# EasyEDA Pro project 2-64 M circuit board.eprj

# Schematic FUJICA AX-5
Create Date: 2026-02-10; Page Name: 2-64 M circuit board; Project Name: 2-64 M circuit board; Schematic Name: FUJICA AX-5; Update Date: 2026-02-10; Company: EasyEDA.com; Page Size: A4; Version: V1.0
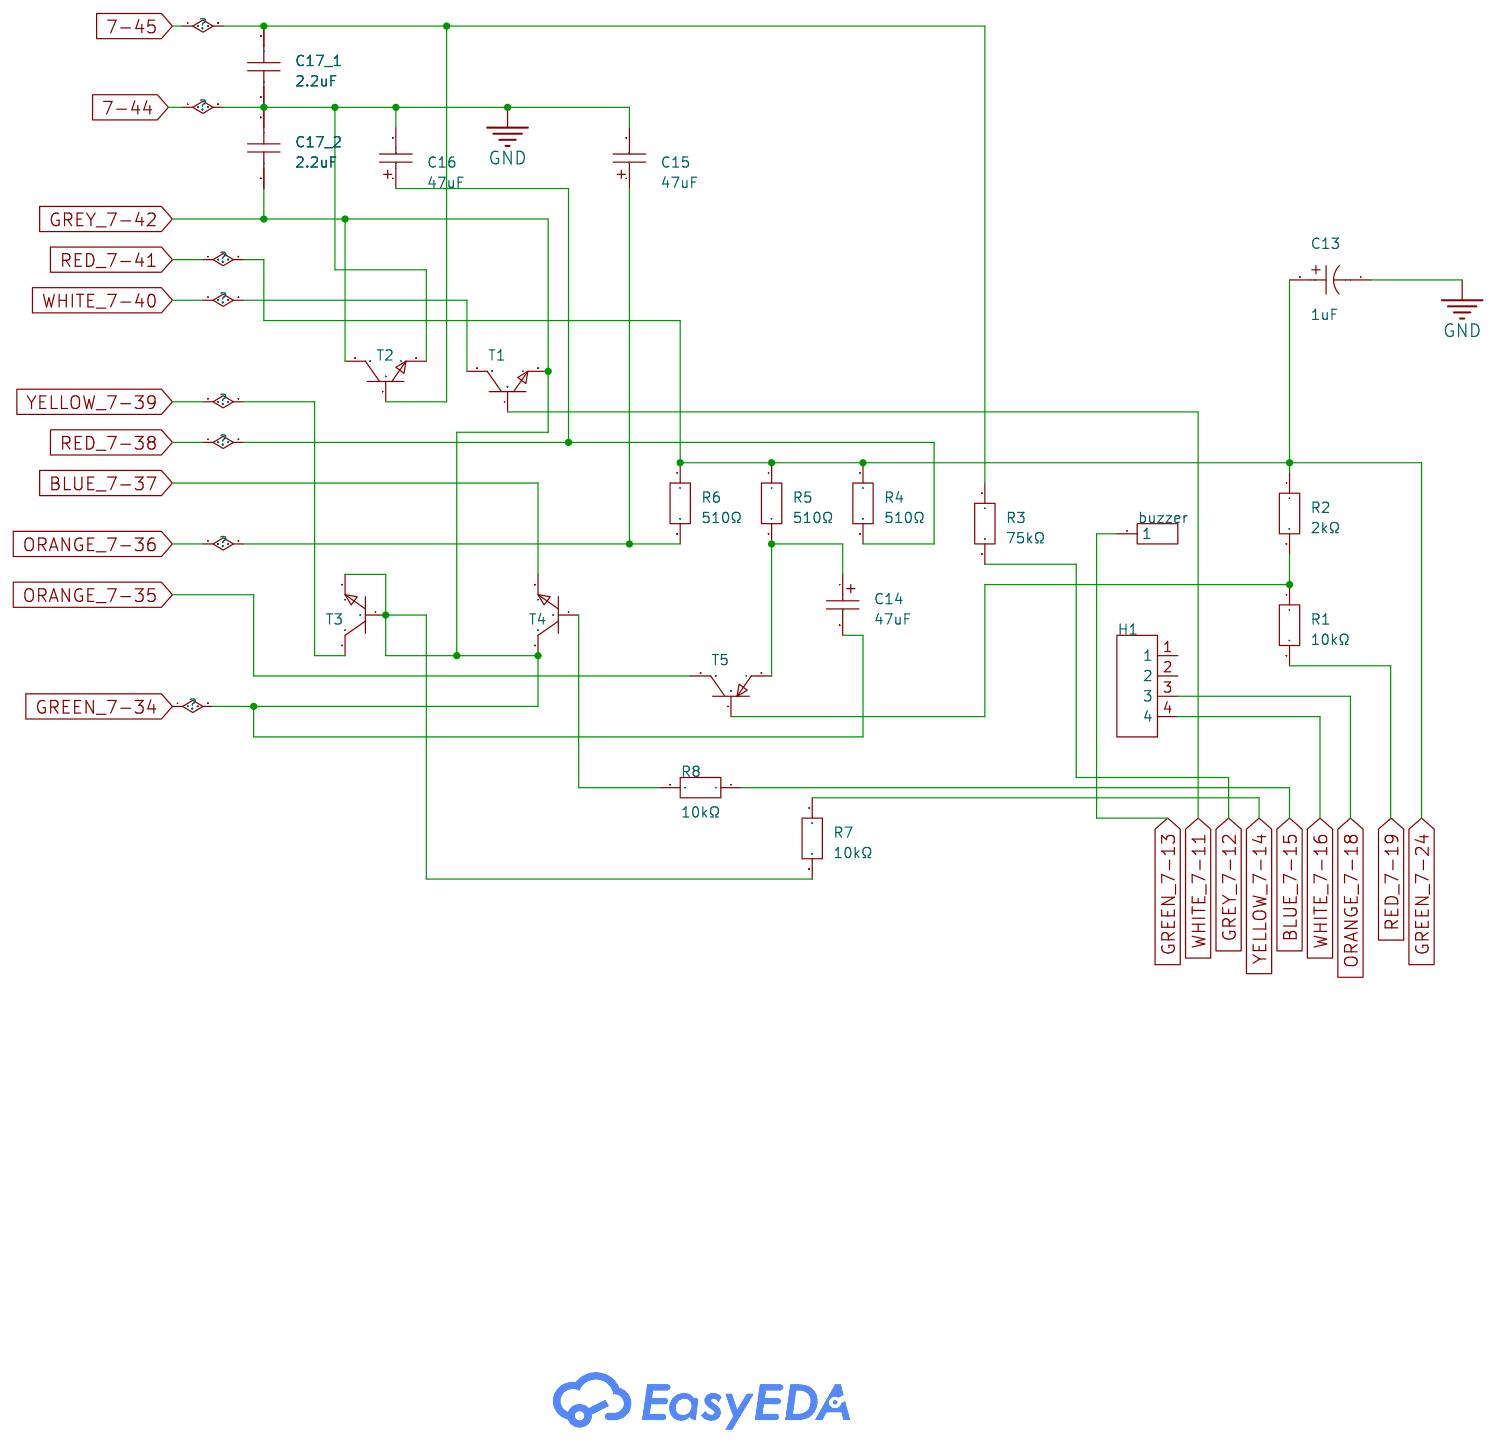
[diagram p0: schematic sheet]

## Parts
buzzer  -  [HDR-TH_1P-V-M_XKB_X4611WV-01I-C28D40]
C13  1uF  [CAP-TH_BD4.5-P2.50-D1.0-FD]
C14  47uF  [CAP-TH_BD5.0-P2.5-D0.5-FD]
C15  47uF  [CAP-TH_BD5.0-P2.5-D0.5-FD]
C16  47uF  [CAP-TH_BD5.0-P2.5-D0.5-FD]
C17_1  2.2uF  [CAP-TH_BD4.5-P2.50-D1.0-FD]
C17_2  2.2uF  [CAP-TH_BD4.5-P2.50-D1.0-FD]
H1  -  [HDR-TH_4P-P2.54-V-M]
R1  510Ω  [RES-TH_BD1.9-L3.3-P7.30-D0.5]
R2  510Ω  [RES-TH_BD1.9-L3.3-P7.30-D0.5]
R3  510Ω  [RES-TH_BD1.9-L3.3-P7.30-D0.5]
R4  510Ω  [RES-TH_BD1.9-L3.3-P7.30-D0.5]
R5  510Ω  [RES-TH_BD1.9-L3.3-P7.30-D0.5]
R6  510Ω  [RES-TH_BD1.9-L3.3-P7.30-D0.5]
R7  510Ω  [RES-TH_BD1.9-L3.3-P7.30-D0.5]
R8  510Ω  [RES-TH_BD1.9-L3.3-P7.30-D0.5]
T1  NPN-sot-23  [SOT-23-3_L2.9-W1.3-P0.95-LS2.4-BR]
T2  NPN-sot-23  [SOT-23-3_L2.9-W1.3-P0.95-LS2.4-BR]
T3  NPN-sot-23  [SOT-23-3_L2.9-W1.3-P0.95-LS2.4-BR]
T4  NPN-sot-23  [SOT-23-3_L2.9-W1.3-P0.95-LS2.4-BR]
T5  PNP-sot-23  [SOT-23-3_L2.9-W1.3-P1.90-LS2.4-BR]

## Library data of the parts
buzzer = HDR-M_2.54_1x1P: Supplier Footprint: Through
C13 = TAP105K035SCS: Capacitance:1uF Tolerance:±10% Tolerance:±10% Voltage Rating:35V Equivalent Series Resistance(ESR):8Ω@100kHz Operating Temperature:-55℃~+125℃ Operating Temperature:-55℃~+125℃; LCSC Part Name: 1uF ±10% 35V; Supplier Part: C2987014; Manufacturer: Kyocera AVX; Supplier Footprint: 插件,P=2.5mm; JLCPCB Part Class: Extended Part; Supplier: LCSC; Tolerance: ±10%; Voltage Rating: 35V; Equivalent Series Resistance(ESR): 8Ω@100kHz; Operating Temperature: -55℃~+125℃
C14-C16 = TAP476K016SCS: Capacitance: Tolerance:±10% Tolerance:±10% Rated Voltage: Equivalent Series Resistance(ESR):1.3Ω@100kHz Operating Temperature:-55℃~+125℃ Operating Temperature:-55℃~+125℃; LCSC Part Name: 47uF ±10% 16V; Supplier Part: C56699; Manufacturer: Kyocera AVX; Supplier Footprint: 插件,P=2.5mm; JLCPCB Part Class: Extended Part; Datasheet: https://atta.szlcsc.com/upload/public/pdf/source/20191107/C444779_CCD9EA7F36AC07ADEC9ACFBB03523055.pdf; Supplier: LCSC; Tolerance: ±10%; Equivalent Series Resistance(ESR): 1.3Ω@100kHz; Operating Temperature: -55℃~+125℃
C17_1 C17_2 = TAP225K035SCS: Capacitance: Tolerance:±10% Tolerance:±10% Rated Voltage: Equivalent Series Resistance(ESR):5Ω@100kHz Operating Temperature:-55℃~+125℃ Operating Temperature:-55℃~+125℃; LCSC Part Name: 2.2uF ±10% 35V; Supplier Part: C50520; Manufacturer: Kyocera AVX; Supplier Footprint: 插件,P=5mm; JLCPCB Part Class: Extended Part; Datasheet: https://atta.szlcsc.com/upload/public/pdf/source/20191107/C444779_CCD9EA7F36AC07ADEC9ACFBB03523055.pdf; Supplier: LCSC; Tolerance: ±10%; Equivalent Series Resistance(ESR): 5Ω@100kHz; Operating Temperature: -55℃~+125℃
H1 = HDR-M_2.54_1x4P: Supplier Footprint: Through
R1-R8 = MF0S4FF5100A50: Type:Metal Film Resistors Resistance:510Ω Tolerance:±1% Tolerance:±1% Power(Watts):250mW; LCSC Part Name: 金属膜电阻 510Ω ±1% 250mW 温漂：±50PPM; Supplier Part: C18724267; Manufacturer: UNI-ROYAL(厚声); Supplier Footprint: 插件,D1.9xL3.3mm; JLCPCB Part Class: Extended Part; Datasheet: https://atta.szlcsc.com/upload/public/pdf/source/20200826/C778422_A75C16D24F3F4B91F841C5277BB30A6A.pdf; Supplier: LCSC; Type: Metal Film Resistors; Tolerance: ±1%; Power(Watts): 250mW
T1-T4 = NPN-sot-23: Supplier Part: C9900005297; Supplier Footprint: SOT-23; JLCPCB Part Class: Extended Part; Supplier: LCSC
T5 = PNP-sot-23: Supplier Part: C9900005269; Supplier Footprint: SOT-23-3; JLCPCB Part Class: Extended Part; Supplier: LCSC

## Nets
GND: C13.1 C15.2 C16.2 C17_1.1 C17_2.2 T2.2(E)
7-45: C17_1.2 R3.1 T2.1(B)
BLUE_7-15: R8.1
BLUE_7-37: T4.2(E)
GREEN_7-13: buzzer.1
GREEN_7-24: C13.2 R2.1 R4.1 R5.1 R6.1
GREEN_7-34: C14.2 C17_2.1 R7.2 T1.2(E) T2.3(C) T3.1(B) T3.2(E) T4.3(C)
GREY_7-12: R3.2
ORANGE_7-18: H1.3
ORANGE_7-35: T5.3(C)
ORANGE_7-36: C15.1 R6.2
RED_7-19: R1.2
RED_7-38: C16.1 R4.2
WHITE_7-11: T1.1(B)
WHITE_7-16: H1.4
WHITE_7-40: T1.3(C)
YELLOW_7-14: R7.1
YELLOW_7-39: T3.3(C)
$C14_1: C14.1 R5.2 T5.2(E)
$R1_1: R1.1 R2.2 T5.1(B)
$R8_2: R8.2 T4.1(B)

Not connected (* = marked no-connect by the designer): H1 1 2

# Board PCB1
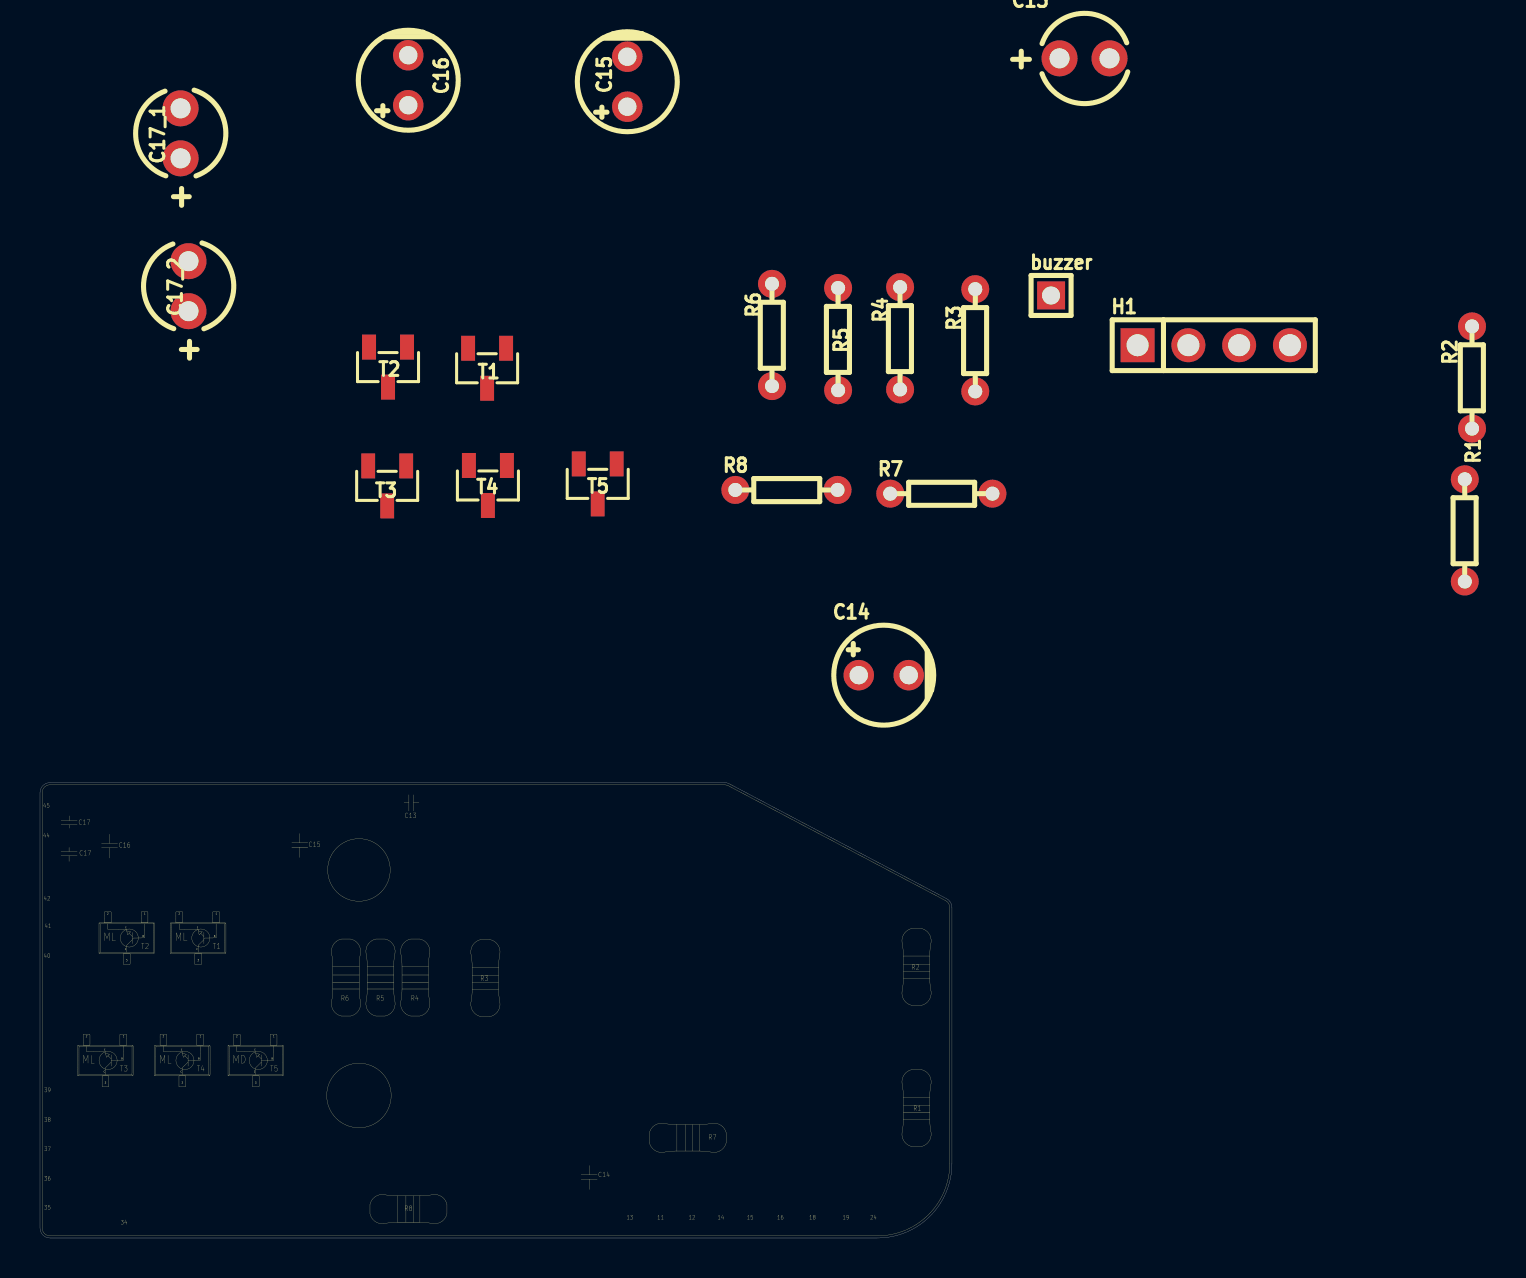
[diagram p1: board, top side]
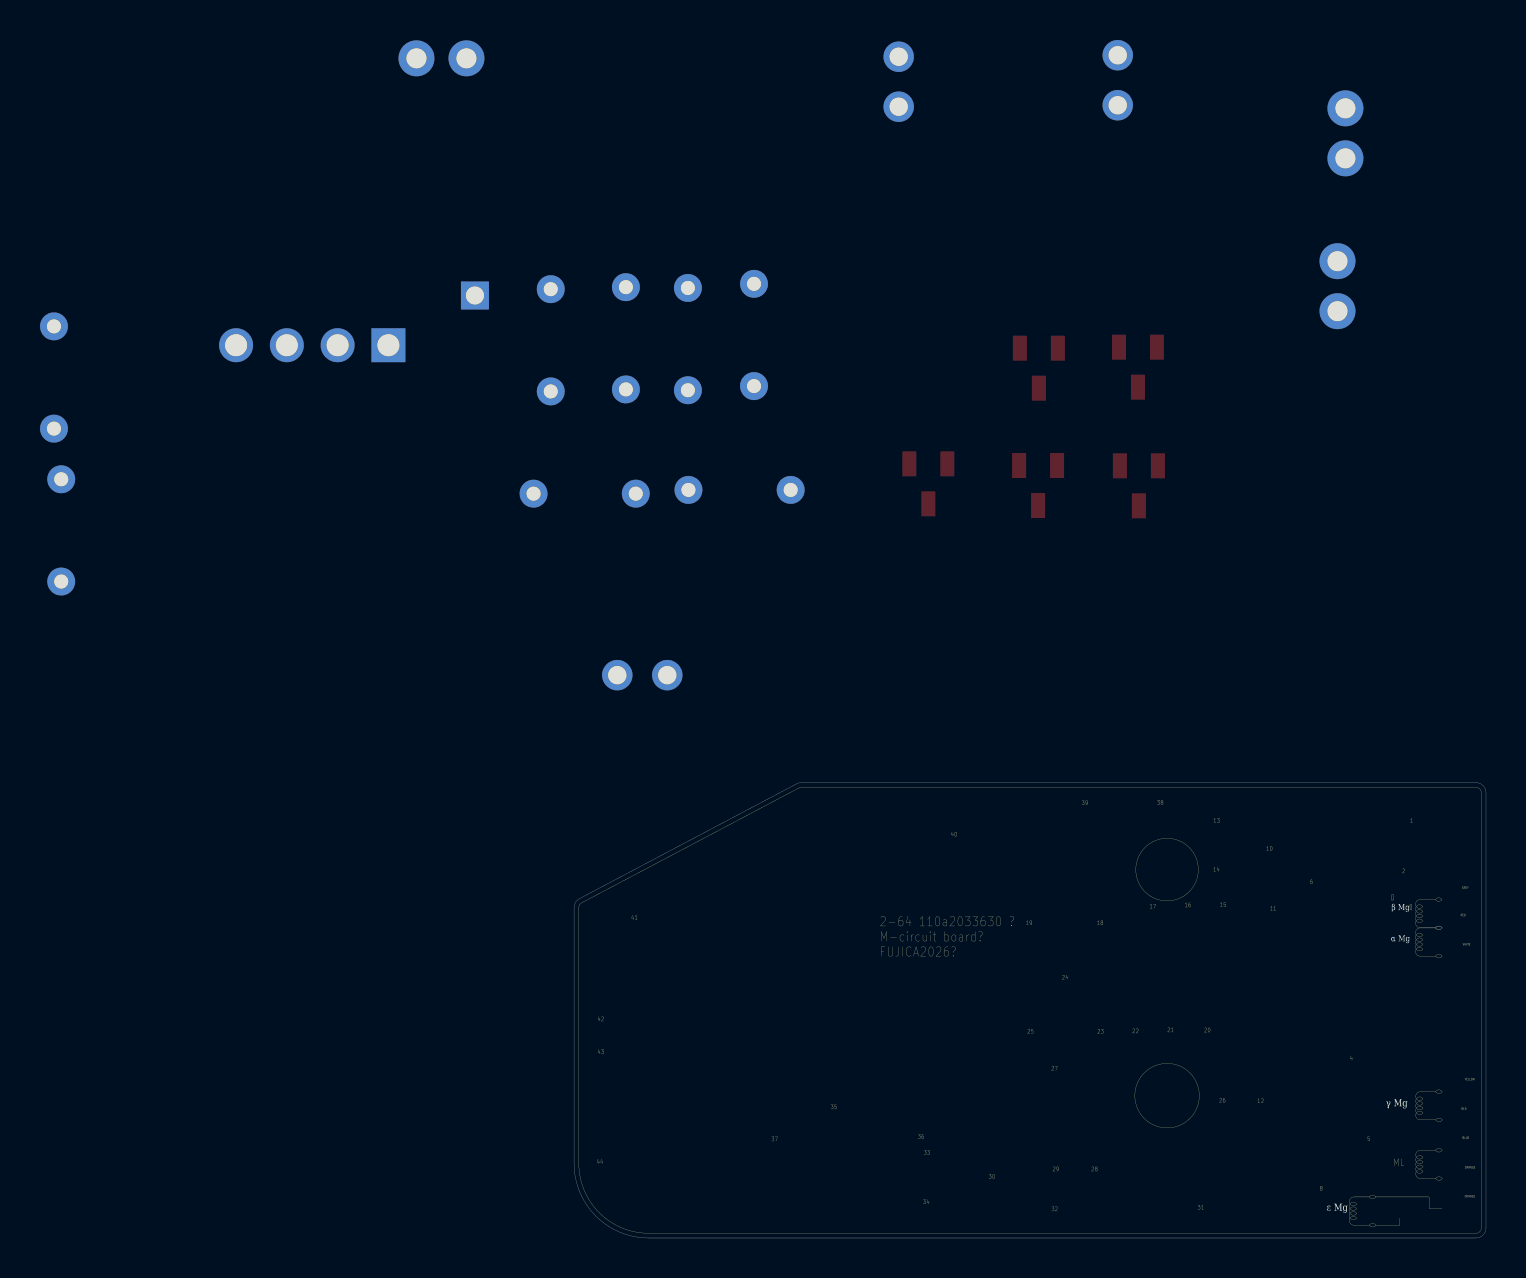
[diagram p2: board, bottom side, seen from below]

Outline 45.61 x 22.77 mm; copper layers: Top Layer, Bottom Layer. Coordinates in mm from the lower left corner of the outline.
Outline path: 0,22.27 0,0.5 arc(0.15,0.15) 0.5,0 41.88,0 arc(44.52,1.09) 45.61,3.73 45.61,16.52 arc(45.54,16.78) 45.35,16.97 34.48,22.71 arc(34.37,22.75) 34.25,22.77 0.5,22.77 arc(0.15,22.62) 0,22.27
Stack: Top Layer 0.035mm / Dielectric1 1.51mm FR4 er 4.5 / Bottom Layer 0.035mm

## Design rules (mm)
template: JLCPCB Capability(Two Layers Board)
spacing copperThickness1oz (default): track to track 0.102, other pairs 0.152 to 0.3
spacing copperThickness2oz: track to track 0.203, other pairs 0.152 to 0.3
track width copperThickness1oz (default): min 0.127, default 0.254, max 2.54
track width copperThickness2oz: min 0.203, default 0.254, max 2.54
differential pair differentialPair (default): width min 0.127, default 0.254, max 2.54; gap min 0.152, default 0.152
via viaSize (default): diameter min 0.5, default 0.61, max 10; hole min 0.3, default 0.305, max 6.3

## Placement (name value [footprint] x y rotation side)
buzzer  -  [HDR-TH_1P-V-M_XKB_X4611WV-01I-C28D40]  50.57 47.13 0 top
C13  1uF  [CAP-TH_BD4.5-P2.50-D1.0-FD]  52.25 58.99 0 top
C14  47uF  [CAP-TH_BD5.0-P2.5-D0.5-FD]  42.2 28.14 0 top
C15  47uF  [CAP-TH_BD5.0-P2.5-D0.5-FD]  29.38 57.82 90 top
C16  47uF  [CAP-TH_BD5.0-P2.5-D0.5-FD]  18.42 57.89 90 top
C17_1  2.2uF  [CAP-TH_BD4.5-P2.50-D1.0-FD]  7.03 55.24 90 top
C17_2  2.2uF  [CAP-TH_BD4.5-P2.50-D1.0-FD]  7.43 47.59 90 top
H1  -  [HDR-TH_4P-P2.54-V-M]  58.71 44.64 0 top
R1  510Ω  [RES-TH_BD1.9-L3.3-P7.30-D0.5]  71.27 35.37 270 top
R2  510Ω  [RES-TH_BD1.9-L3.3-P7.30-D0.5]  71.63 43.01 270 top
R3  510Ω  [RES-TH_BD1.9-L3.3-P7.30-D0.5]  46.78 44.87 270 top
R4  510Ω  [RES-TH_BD1.9-L3.3-P7.30-D0.5]  43.02 44.97 270 top
R5  510Ω  [RES-TH_BD1.9-L3.3-P7.30-D0.5]  39.92 44.93 270 top
R6  510Ω  [RES-TH_BD1.9-L3.3-P7.30-D0.5]  36.61 45.14 270 top
R7  510Ω  [RES-TH_BD1.9-L3.3-P7.30-D0.5]  45.1 37.22 0 top
R8  510Ω  [RES-TH_BD1.9-L3.3-P7.30-D0.5]  37.35 37.41 0 top
T1  NPN-sot-23  [SOT-23-3_L2.9-W1.3-P0.95-LS2.4-BR]  22.36 43.49 90 top
T2  NPN-sot-23  [SOT-23-3_L2.9-W1.3-P0.95-LS2.4-BR]  17.41 43.55 90 top
T3  NPN-sot-23  [SOT-23-3_L2.9-W1.3-P0.95-LS2.4-BR]  17.36 37.61 90 top
T4  NPN-sot-23  [SOT-23-3_L2.9-W1.3-P0.95-LS2.4-BR]  22.41 37.63 90 top
T5  PNP-sot-23  [SOT-23-3_L2.9-W1.3-P1.90-LS2.4-BR]  27.9 37.71 90 top

## Footprints (pads in the part's own frame, mm; a bottom-side part is the same pattern mirrored in y, then rotated)
CAP-TH_BD4.5-P2.50-D1.0-FD
  round 1.8 hole 1: 1(-1.25,0) 2(1.25,0)
CAP-TH_BD5.0-P2.5-D0.5-FD
  round 1.524 hole 0.914: 1(-1.25,0) 2(1.25,0)
HDR-TH_1P-V-M_XKB_X4611WV-01I-C28D40
  rect 1.4x1.4 hole 0.9: 1(0,0)
HDR-TH_4P-P2.54-V-M
  rect 1.7x1.7 hole 1.1: 1(-3.81,0)
  round 1.7 hole 1.1: 2(-1.27,0) 3(1.27,0) 4(3.81,0)
RES-TH_BD1.9-L3.3-P7.30-D0.5
  round 1.4 hole 0.7: 1(-2.572,0) 2(2.541,0)
SOT-23-3_L2.9-W1.3-P0.95-LS2.4-BR
  rect 1.25x0.7 smd: 1(1,-0.95) 2(1,0.95) 3(-1,0)
SOT-23-3_L2.9-W1.3-P1.90-LS2.4-BR
  rect 1.25x0.7 smd: 1(1,-0.95) 2(1,0.95) 3(-1,0)

## Nets
As in the schematic.

Pads without a net: H1 1 2

## Text on the board
Bottom Silkscreen Layer: ORANGE | YELLOW | WHITE | BLUE | GREY | RED | 1 | 2 | 5 | 4 | 8 | 6 | 11 | 10 | 12 | 15 | 26 | 13 | 14 | 20 | 31 | 16 | 21 | 38 | 17 | 22 | 23 | 18 | 28 | 39 | 24 | 29 | 32 | 27 | 25 | 19 | 30 | 40 | 33 | 34 | 36 | 35 | 37 | 41 | 42 | 43 | 44 | ML | 2-64 110a2033630 / M-circuit board / FUJICA2026 | β Mg | α Mg | γ Mg | ε Mg
Top Silkscreen Layer: C | E | B | 2 | 3 | 1 | 45 | 44 | 42 | 40 | 39 | 38 | 37 | 36 | 35 | 41 | 34 | 13 | 11 | 12 | 14 | 15 | 16 | 18 | 19 | 24 | C17 | C16 | C15 | C13 | C14 | R6 | R5 | R8 | R4 | R3 | R7 | R2 | R1 | T3 | T2 | T4 | T1 | T5 | ML | MD
DXF ROUTE BOTTOM: 1 | 2 | 3 | 4 | 7 | 8 | 6 | 9 | 11 | 10 | 12 | 13 | 14 | 20 | 15 | 21 | 16 | 17 | 38 | 23 | 18 | 39 | 24 | 29 | 32 | 27 | 25 | 19 | 40 | 34 | 36 | 35 | 44 | 41 | 5 | 26 | 31 | 22 | 28 | 30 | 33 | 37 | 43 | 45 | 42
